# EasyEDA Pro project Priestess视频同款版.eprj

# Schematic Schematic2
Board Name: Board2; Create Date: 2025-03-19; Page Name: P1; Project Name: 通行证1.1 lisa; Schematic Name: Schematic2; Update Date: 2025-03-19; Company: 嘉立创EDA; Page Size: A4; Version: V1.0
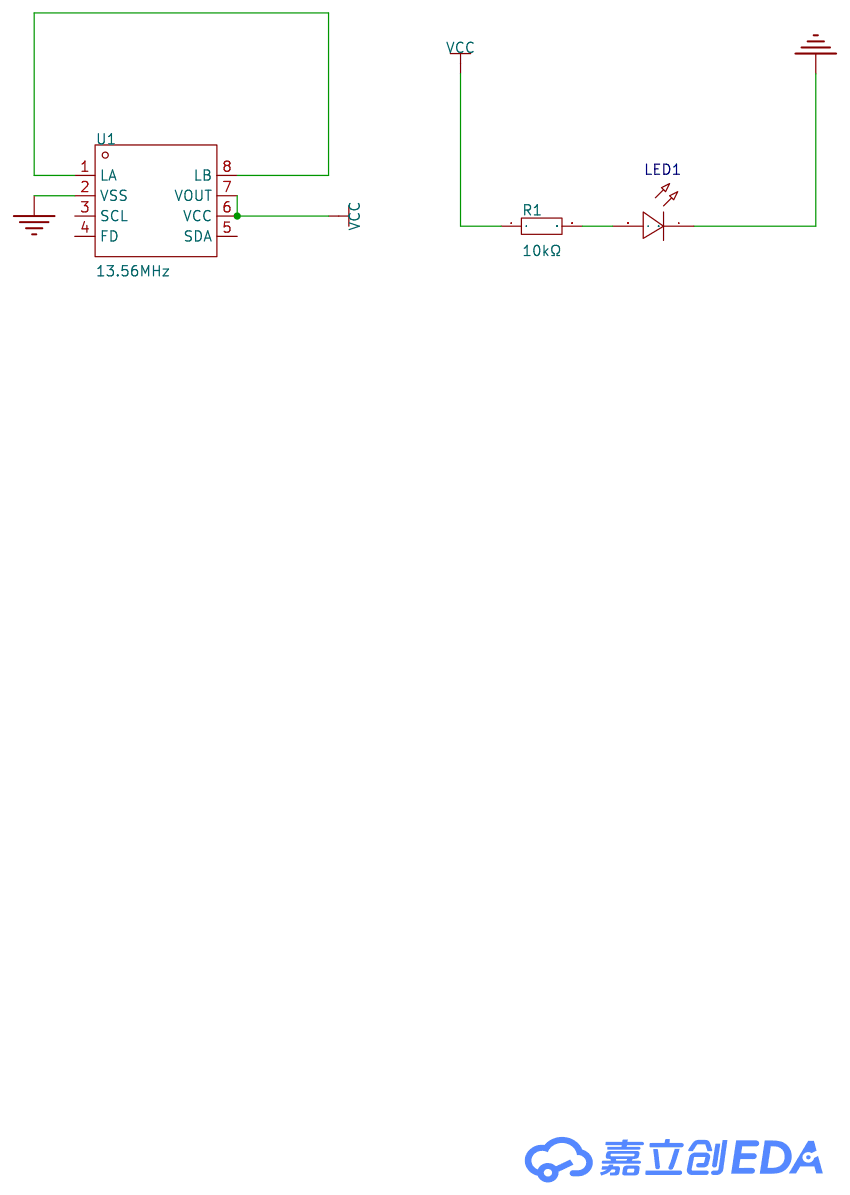
[diagram p0: schematic sheet]

## Parts
LED1  -  [LED_0402]
R1  10kΩ  [R0402]
U1  13.56MHz  [XQFN-8_L1.6-W1.6-P0.50-BL_NT3H2111W0FHKH]

## Library data of the parts
LED1 = LED_0402-B: Supplier Footprint: 0402
R1 = 0402WGF1002TCE: 电阻类型:厚膜电阻;阻值:10kΩ;精度:±1%;功率:62.5mW;最大工作电压:50V;温度系数:±100ppm/℃;; LCSC Part Name: 10kΩ ±1% 62.5mW 厚膜电阻; Supplier Part: C25744; Manufacturer: UNI-ROYAL(厚声); Supplier Footprint: 0402; JLCPCB Part Class: 基础库; Datasheet: https://atta.szlcsc.com/upload/public/pdf/source/20200306/C422600_1E6D84923E4A46A82E41ADD87F860B5C.pdf; Supplier: LCSC; Type: 厚膜电阻; Tolerance: ±1%; Power(Watts): 62.5mW; Overload Voltage (Max): 50V; Temperature Coefficient: ±100ppm/℃; Operating Temperature Range: -55℃~+155℃
U1 = NT3H2111W0FHKH: 协议:ISO 14443;接口类型:I2C;; Supplier Part: C710403; Manufacturer: NXP(恩智浦); Supplier Footprint: XQFN-8(1.6x1.6); JLCPCB Part Class: 扩展库; Datasheet: https://www.nxp.com/docs/en/data-sheet/NT3H2111_2211.pdf; Supplier: LCSC; agreement: ISO 14443; interface type: I2C; mains input: 3.3V

## Nets
GND: LED1.1(C) U1.2(VSS)
VCC: R1.1 U1.6(VCC) U1.7(VOUT)
$1N388: U1.1(LA) U1.8(LB)
$1N744: LED1.2(A) R1.2

Not connected (* = marked no-connect by the designer): U1 3(SCL) 4(FD) 5(SDA)

# Board PCB2
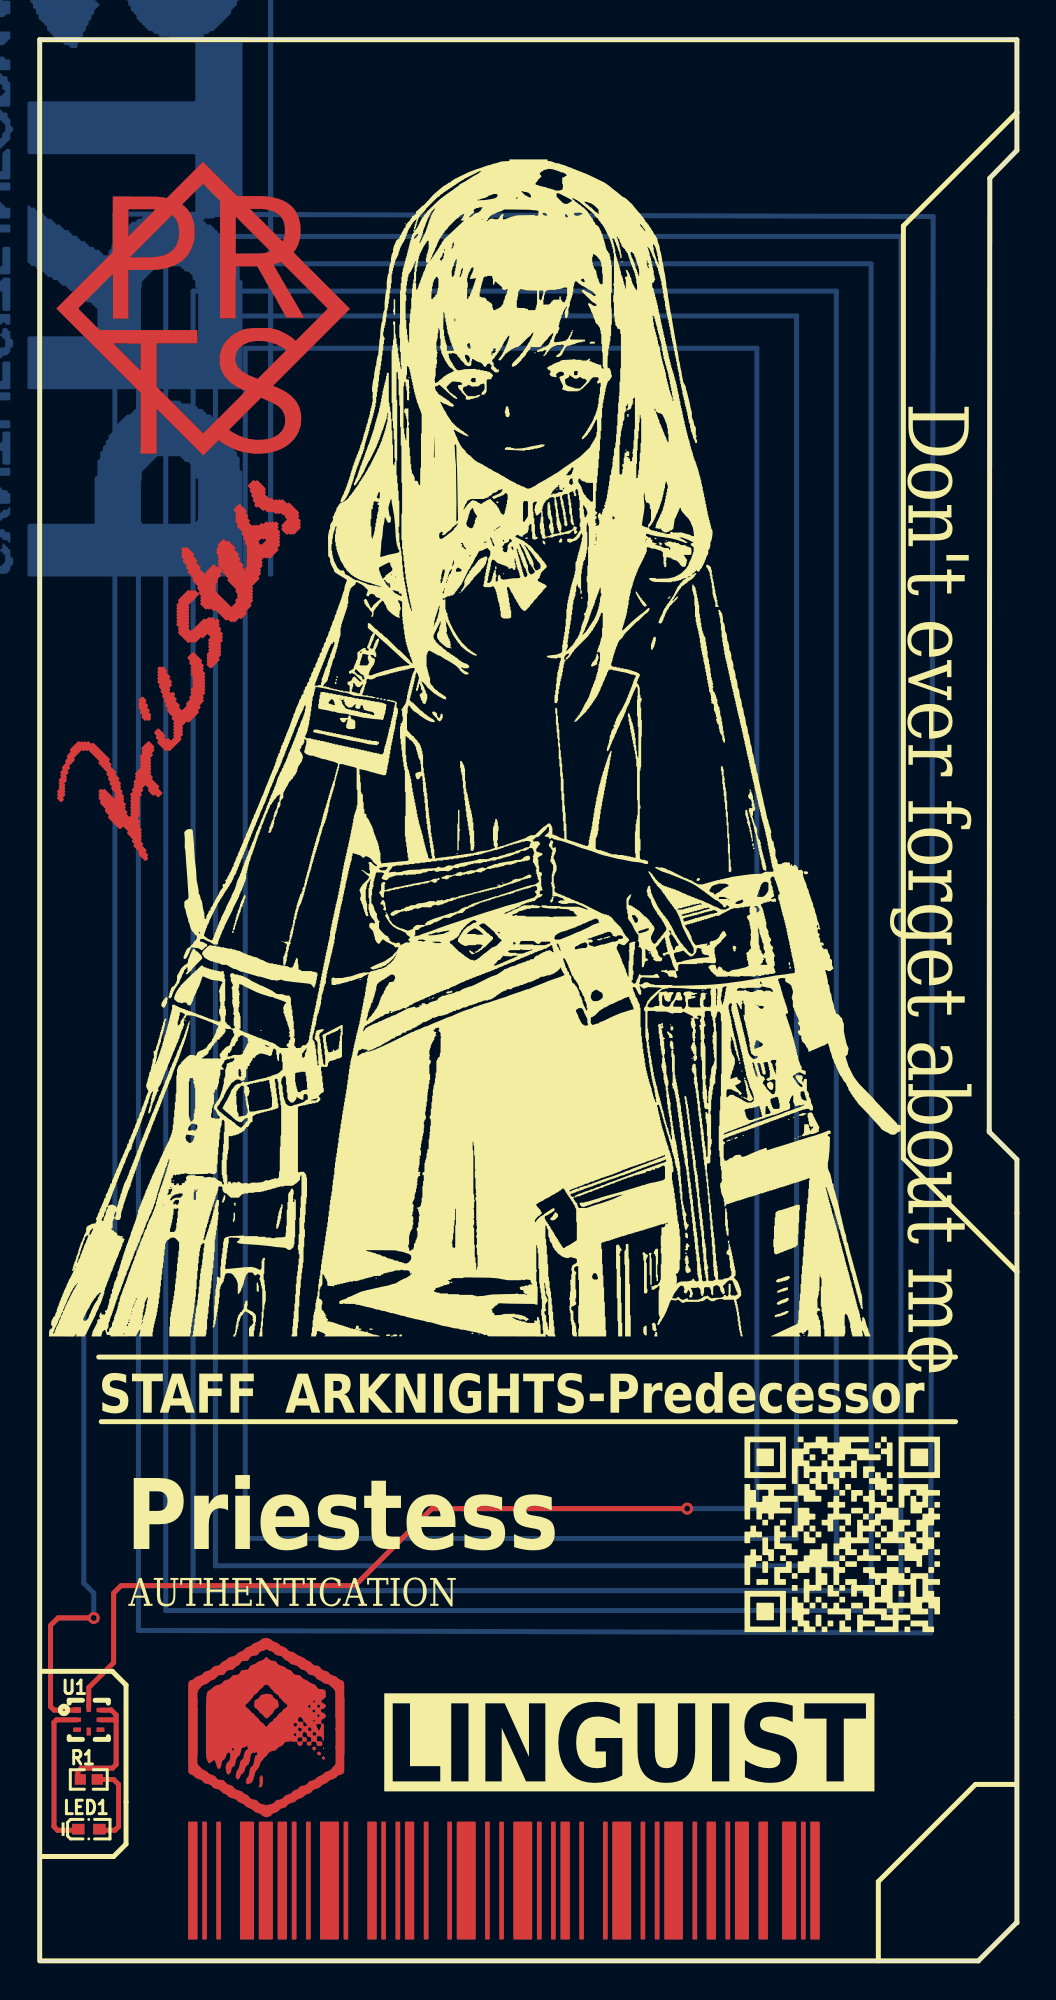
[diagram p1: board, top side]
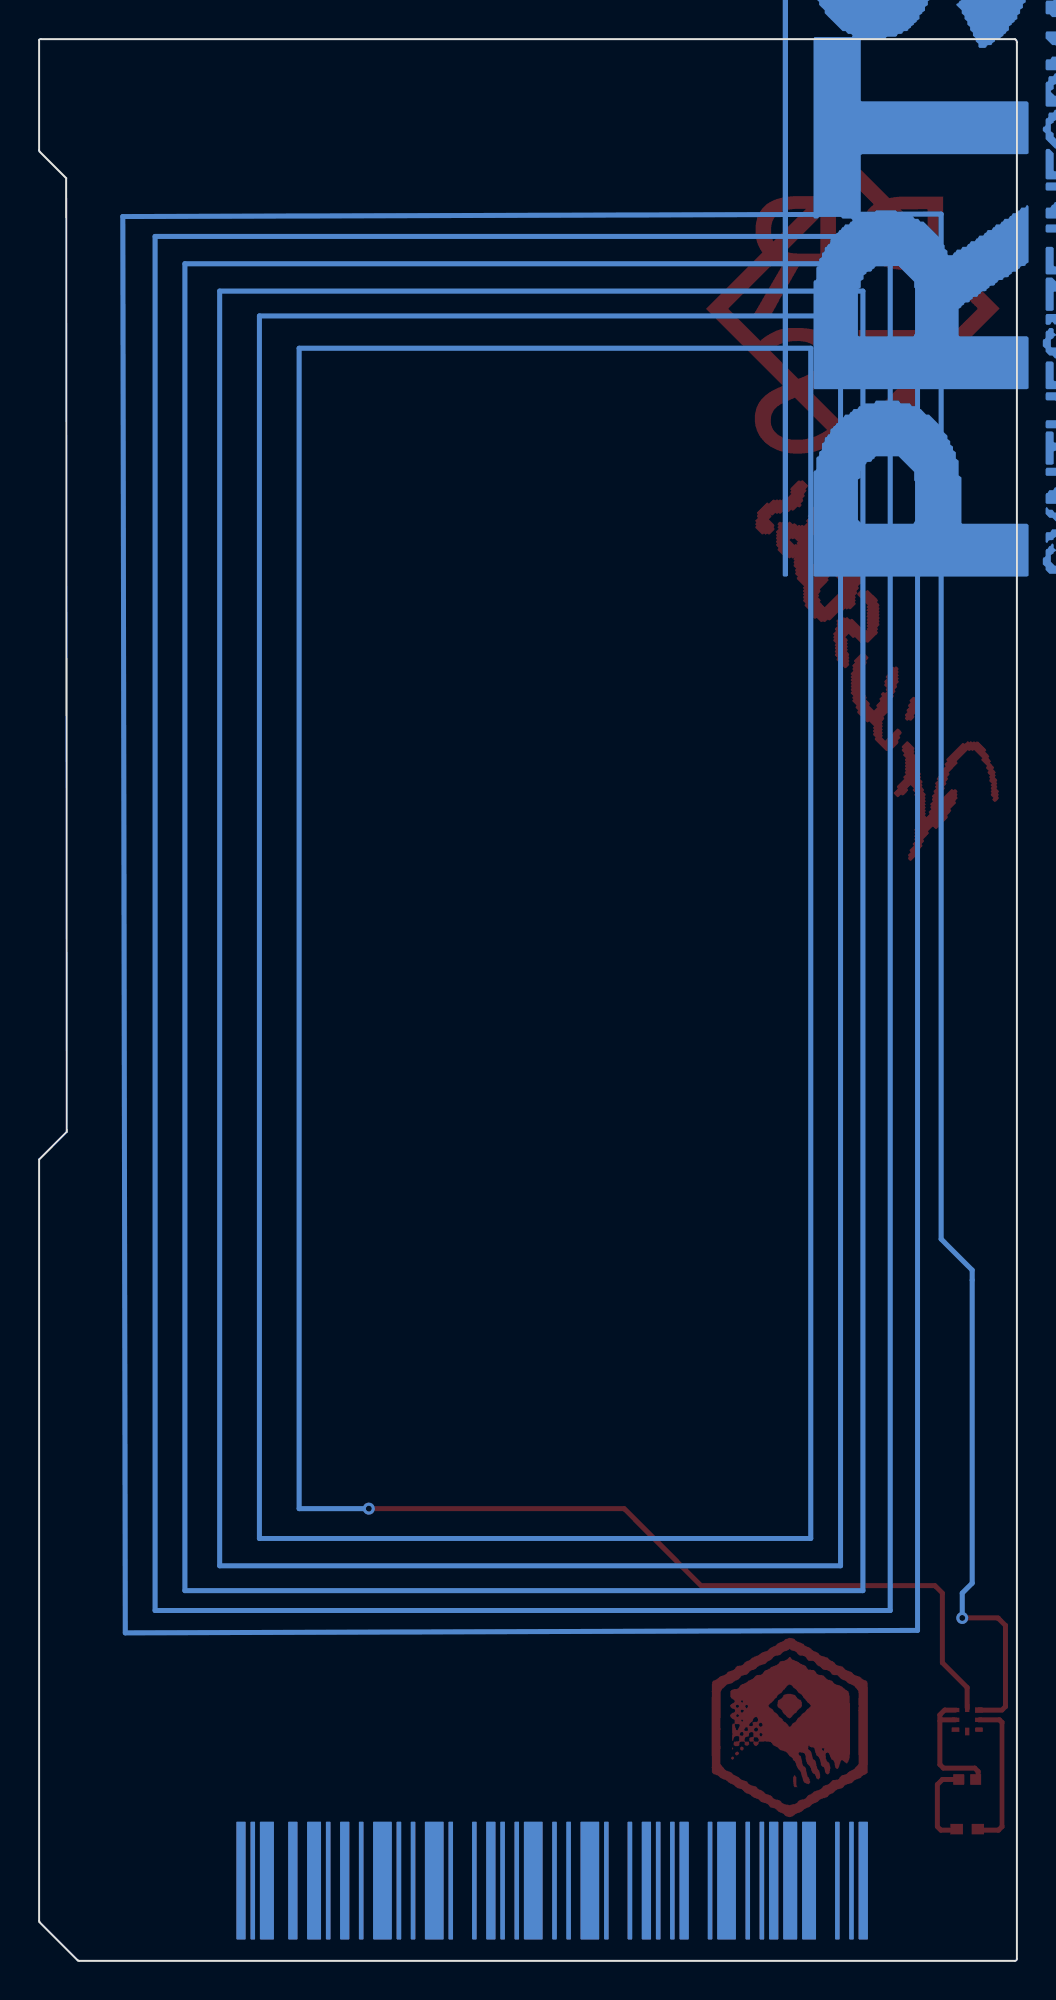
[diagram p2: board, bottom side, seen from below]

Outline 50 x 98.22 mm; copper layers: Top Layer, Bottom Layer. Coordinates in mm from the lower left corner of the outline.
Outline path: 0,98.05 arc(0.02,98.15) 0.1,98.22 49.9,98.22 arc(49.96,98.22) 50,98.16 50,92.54 arc(49.99,92.5) 49.97,92.47 48.62,91.12 48.59,42.46 48.59,42.37 50,40.96 50,2.04 arc(49.99,2) 49.97,1.97 48.03,0.03 arc(48,0.01) 47.96,0 0.1,0 arc(0.03,0.03) 0,0.1 0,98.05
Stack: Top Layer 0.035mm / Dielectric1 1.51mm FR4 er 4.5 / Bottom Layer 0.035mm

## Design rules (mm)
template: JLCPCB Capability(Two Layers Board)
spacing copperThickness1oz (default): track to track 0.102, other pairs 0.152 to 0.3
spacing copperThickness2oz: track to track 0.203, other pairs 0.152 to 0.3
track width copperThickness1oz (default): min 0.127, default 0.254, max 2.54
track width copperThickness2oz: min 0.203, default 0.254, max 2.54
differential pair differentialPair (default): width min 0.127, default 0.254, max 2.54; gap min 0.152, default 0.152
via viaSize (default): diameter min 0.5, default 0.61, max 10; hole min 0.3, default 0.305, max 6.3

## Placement (name value [footprint] x y rotation side)
LED1  -  [LED_0402]  2.54 6.73 0 top
R1  10kΩ  [R0402]  2.54 9.27 0 top
U1  13.56MHz  [XQFN-8_L1.6-W1.6-P0.50-BL_NT3H2111W0FHKH]  2.54 12.32 0 top

## Footprints (pads in the part's own frame, mm; a bottom-side part is the same pattern mirrored in y, then rotated)
LED_0402
  rect 0.637x0.541 smd: 1(-0.538,0) 2(0.538,0)
R0402
  rect 0.566x0.54 smd: 1(-0.433,0) 2(0.433,0)
XQFN-8_L1.6-W1.6-P0.50-BL_NT3H2111W0FHKH
  rect 0.4x0.28 smd: 1(-0.6,0.5)
  rect 0.4x0.22 smd: 2(-0.6,0) 3(-0.6,-0.5) 5(0.6,-0.5) 6(0.6,0) 7(0.6,0.5)
  rect 0.22x0.4 smd: 4(0,-0.6) 8(0,0.6)

## Nets
As in the schematic.

Pads without a net: U1 3 4 5

## Via types
v1: diameter 0.61, hole 0.305, Top Layer to Bottom Layer, 2 vias

## Routing (per net, layer and track width the routed paths; a pad name or vN(x,y) marks a point on that pad's centre or on a via; arc(x,y) is an arc through that point)
GND: length 7.9
  Top Layer w0.254: U1.2 0.89,12.32 0.76,12.19 0.76,6.86 0.94,6.68 1.95,6.68 LED1.1
VCC: length 6.8
  Top Layer w0.254: 3.94,12.27 3.94,10.03 3.76,9.85 2.16,9.85 1.98,9.67 1.98,9.4 R1.1 ; 3.94,12.27 3.94,12.57 3.69,12.82 U1.7 ; 3.94,12.27 3.89,12.32 U1.6
$1N388: length 1228.7
  Top Layer w0.254: v1(33.14,23.11) 20.08,23.11 16.15,19.18 4.19,19.18 3.81,18.8 3.81,15.24 2.54,13.97 2.54,12.92 ; U1.1 0.76,12.82 0.58,13 0.58,17.15 0.96,17.53 v1(2.79,17.53)
  Bottom Layer w0.254: v1(2.79,17.53) 2.79,18.8 2.29,19.3 2.29,35.31 3.87,36.89 3.87,89.28 45.72,89.15 45.59,16.76 5.08,16.89 5.08,88.14 44.07,88.14 44.07,17.91 6.48,17.91 6.48,86.74 42.55,86.74 42.55,18.92 7.87,18.92 7.87,85.34 40.77,85.34 40.77,20.19 9.02,20.19 9.02,84.07 38.74,84.07 38.74,21.59 10.54,21.59 10.54,82.42 36.7,82.42 36.7,23.11 v1(33.14,23.11)
$1N744: length 4.4
  Top Layer w0.254: R1.2 3.81,9.27 4.06,9.02 4.06,6.86 3.88,6.68 3.13,6.68 LED1.2

Small or netless copper shapes (teardrops, artwork), in the pictures only: 54 on Top Layer, 69 on Bottom Layer

## Text on the board
Top Silkscreen Layer: ARKNIGHTS-Predecessor | LINGUIST | Priestess | STAFF | AUTHENTICATION | Don't ever forget about me.
